# EasyEDA Pro project PR.eprj, board 新大符2.0（下单PCB） (continued)
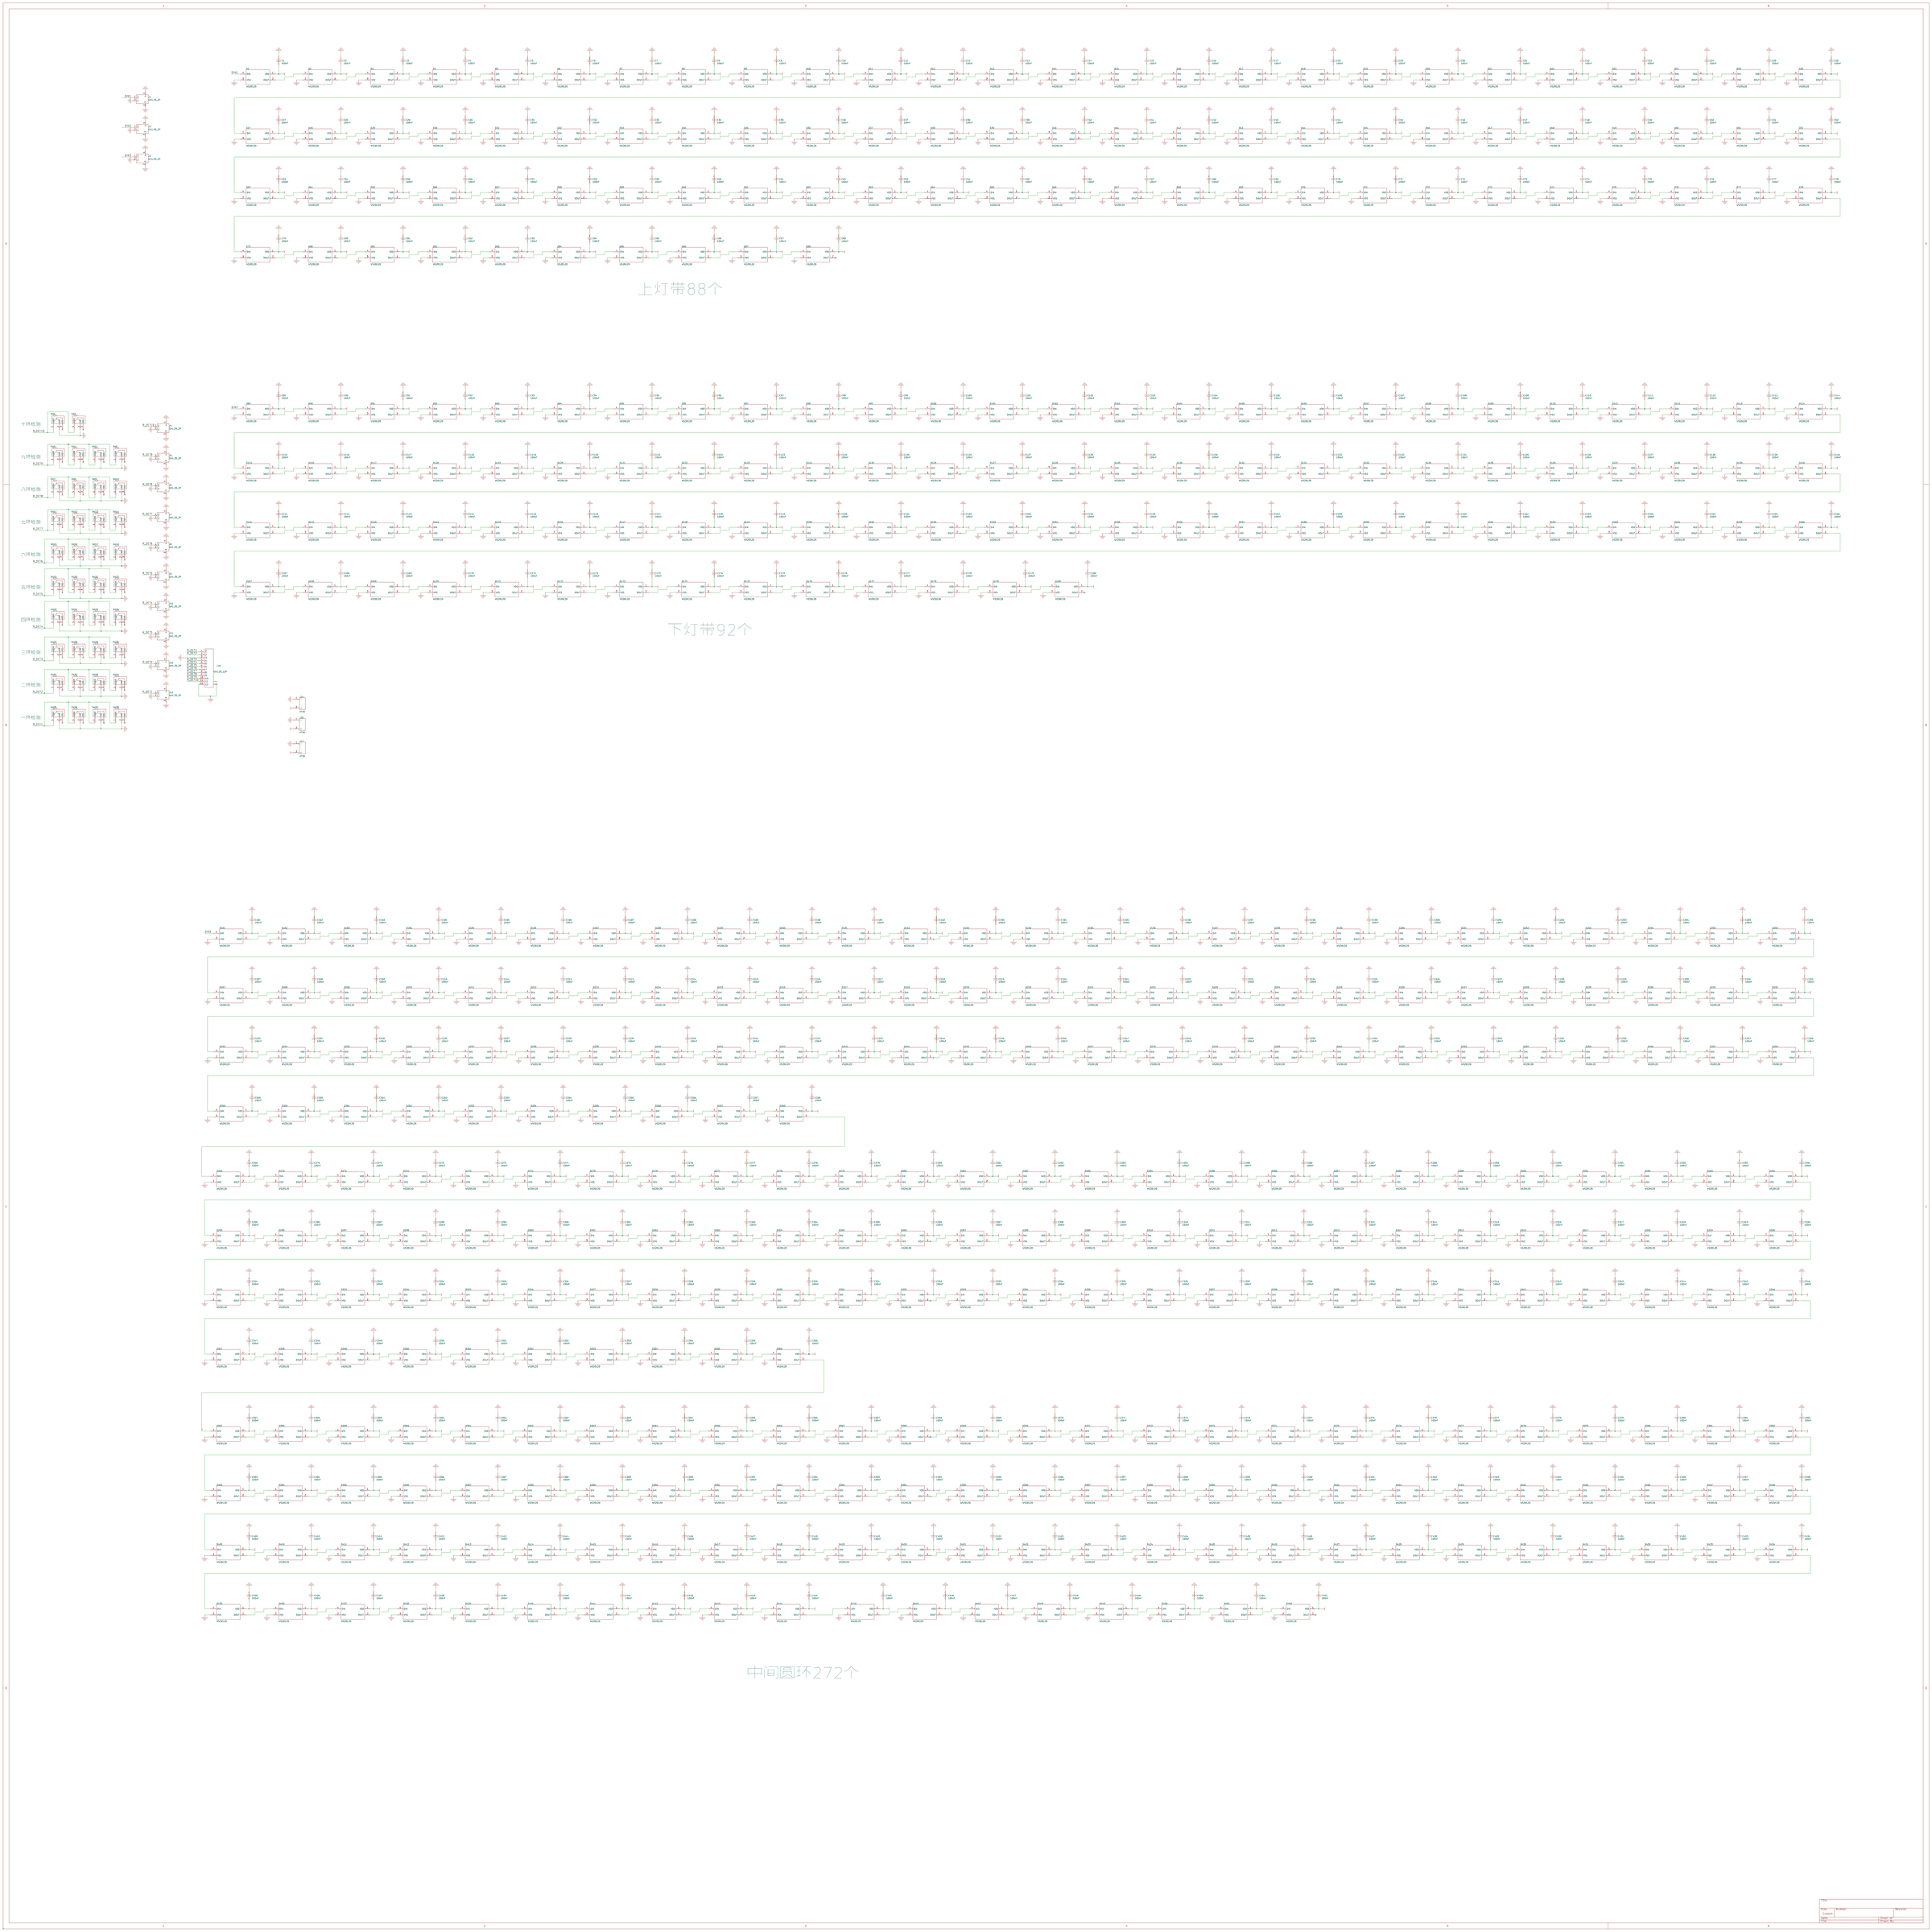
[diagram p0: schematic sheet]
## Routing (per net, layer and track width the routed paths; a pad name or vN(x,y) marks a point on that pad's centre or on a via; arc(x,y) is an arc through that point) (continued)
NETD114_2: length 8.5
  Top Layer w0.381: D115.4 92.55,38.73 arc(93.1,39.55) 93.3,40.52 D114.2
NETD115_2: length 7.7
  Top Layer w0.381: D115.2 89.87,28.82 arc(89.67,27.84) 89.12,27.02 87.68,25.58 arc(86.86,25.03) 85.89,24.84 D116.4
NETD116_2: length 34.1
  Top Layer w0.381: D116.2 86.16,19.52 107.42,44.55 D117.4
NETD117_2: length 9.1
  Top Layer w0.381: 109.33,39.24 109.33,38.52 arc(109.14,37.55) 108.59,36.73 D118.4
NETD118_2: length 8.4
  Top Layer w0.381: D118.2 105.49,26.15 arc(105.29,25.18) 104.74,24.35 102.54,22.15 arc(101.72,21.6) 100.75,21.41 D119.4
NETD119_2: length 33
  Top Layer w0.381: D119.2 101.65,16.1 123.01,39.53 D120.4
NETD120_2: length 9.1
  Top Layer w0.381: D121.4 119.8,28.39 arc(120.77,28.59) 121.59,29.14 124.17,31.72 arc(124.73,32.54) 124.92,33.51 D120.2
NETD121_2: length 8.1
  Top Layer w0.381: D122.4 116.24,18.23 arc(117.21,18.43) 118.04,18.98 119.73,20.67 arc(120.28,21.49) 120.47,22.47 D121.2
NETD122_2: length 31.7
  Top Layer w0.381: D123.4 135.58,36.74 116.64,12.92 D122.2
NETD123_2: length 8
  Top Layer w0.381: D123.2 137.49,31.38 arc(137.3,30.41) 136.75,29.58 D124.4
NETD124_2: length 7.9
  Top Layer w0.381: D125.4 arc(129.43,14.31) 130.04,14.73 133.23,17.92 arc(133.75,18.7) D124.2
NETD125_2: length 32.2
  Top Layer w0.381: D126.4 148.79,33.82 130.61,8.86 D125.2
NETD126_2: length 8
  Top Layer w0.381: D127.4 146.47,23.44 arc(147.44,23.63) 148.26,24.18 149.37,25.29 arc(150.23,26.5) 150.66,27.92 D126.2
NETD127_2: length 7.5
  Top Layer w0.381: D128.4 146.27,15.49 arc(146.82,16.31) 147.02,17.28 D127.2
NETD128_2: length 31.6
  Top Layer w0.381: D128.2 144.58,6.57 146.33,9.69 arc(146.33,9.7) 146.34,9.71 158.06,33.77 D129.4
NETD129_2: length 7.5
  Top Layer w0.381: D130.4 160.93,24.7 arc(161.48,25.52) 161.67,26.5 D129.2
NETD130_2: length 8.8
  Top Layer w0.381: D130.2 162.42,16.03 arc(162.23,15.06) 161.68,14.23 159.41,11.97 arc(158.72,11.5) D131.4
NETD131_2: length 30.4
  Top Layer w0.381: D132.4 172.81,33.89 161.51,7 D131.2
NETD132_2: length 7.8
  Top Layer w0.381: D133.4 175.67,25.27 arc(176.22,26.09) 176.42,27.06 D132.2
NETD133_2: length 8.3
  Top Layer w0.381: D133.2 176.6,16.5 arc(176.41,15.53) 175.86,14.71 D134.4
NETD134_2: length 30.1
  Top Layer w0.381: D134.2 176.1,7 186.58,33.89 D135.4
NETD135_2: length 7.7
  Top Layer w0.381: D135.2 190.19,26.66 arc(190,25.69) 189.45,24.86 D136.4
NETD136_2: length 8.1
  Top Layer w0.381: D136.2 190.78,16.1 arc(190.59,15.13) 190.04,14.3 D137.4
NETD137_2: length 30.2
  Top Layer w0.381: D137.2 190.68,7 201.35,33.89 D138.4
NETD138_2: length 7.9
  Top Layer w0.381: D138.2 204.96,27.25 arc(204.77,26.28) 204.22,25.45 D139.4
NETD139_2: length 7.9
  Top Layer w0.381: D140.4 204.22,13.9 arc(204.77,14.72) 204.96,15.69 D139.2
NETD140_2: length 30.4
  Top Layer w0.381: D141.4 213.81,34.89 205.27,7 D140.2
NETD141_2: length 7.8
  Top Layer w0.381: 216.77,23.57 216.98,24.18 217.78,28.49 arc(217.78,28.51) 217.79,28.54 217.91,30.64 D141.2
NETD142_2: length 8
  Top Layer w0.381: D142.2 220.66,18.72 220.58,16.48 arc(220.57,16.42) 220.56,16.36 219.01,12.26 D143.4
NETD143_2: length 30.9
  Top Layer w0.381: D143.2 223.11,8 227.42,37.34 D144.4
NETD144_2: length 7.9
  Top Layer w0.381: D144.2 231.52,33.08 231.5,30.97 arc(231.5,30.95) 231.5,30.93 231.03,26.48 D145.4
NETD145_2: length 7.7
  Top Layer w0.381: D146.4 233.87,14.67 234.67,18.84 arc(234.68,18.87) 234.68,18.9 234.72,21.02 D145.2
NETD146_2: length 31.1
  Top Layer w0.381: D147.4 241.02,40.13 237.97,10.42 D146.2
NETD147_2: length 8.1
  Top Layer w0.381: D147.2 245.12,35.88 245.09,29.02 244.88,28.42
NETD148_2: length 8
  Top Layer w0.381: D149.4 247.91,16.92 248.64,21.39 arc(248.65,21.41) 248.65,21.43 248.78,23.56 D148.2
NETD149_2: length 31.1
  Top Layer w0.381: 254.83,43.02 254.62,42.42 252.01,12.67 251.8,12.07
NETD150_2: length 8.2
  Top Layer w0.381: D151.4 258.19,31.48 arc(258.74,32.3) 258.93,33.28 D150.2
NETD151_2: length 7.9
  Top Layer w0.381: D152.4 261.56,19.5 261.56,26.1 D151.2
NETD152_2: length 31.2
  Top Layer w0.381: D152.2 265.66,15.24 268.23,45.08 D153.4
NETD153_2: length 7.8
  Top Layer w0.381: D154.4 273.2,34.35 272.33,40.83 D153.2
NETD154_2: length 8
  Top Layer w0.381: D154.2 277.1,24.64 arc(276.9,23.67) 276.35,22.85 D155.4
NETD155_2: length 30.2
  Top Layer w0.381: D155.2 279.88,18.42 281.1,47.33 D156.4
NETD156_2: length 8.4
  Top Layer w0.381: 286.71,36.22 286.81,36.85 286.26,41.68 arc(286.26,41.69) 286.26,41.7 285.88,43.86 D156.2
NETD157_2: length 7.1
  Top Layer w0.381: D157.2 291.76,32.47 arc(292.31,31.65) 292.51,30.67 D158.4
NETD158_2: length 28.4
  Top Layer w0.381: D159.4 295.96,50.26 297.38,23.15 297.28,22.52
NETD159_2: length 7.7
  Top Layer w0.381: D160.4 301.46,45.91 arc(301.3,46.72) 300.84,47.41
NETD160_2: length 7.7
  Top Layer w0.381: 306.86,28.79 306.86,34.86 arc(306.7,35.67) D160.2
NETD161_2: length 28.6
  Top Layer w0.381: D162.4 309.2,53.18 311.73,25.94 D161.2
NETD162_2: length 11.2
  Top Layer w0.381: D162.2 319.15,48.85 arc(319.7,48.03) 319.9,47.06 D163.4
NETD163_2: length 10.5
  Top Layer w0.381: D163.2 330.2,38.92 arc(330.75,38.1) 330.95,37.13 D164.4
NETD164_2: length 37.7
  Top Layer w0.381: D164.2 336.59,34.83 315.94,64.87 D165.4
NETD165_2: length 11.6
  Top Layer w0.381: D166.4 328.48,60.62 arc(328.28,61.59) 327.73,62.41 324.11,66.03 arc(323.29,66.58) 322.32,66.78 D165.2
NETD166_2: length 10.7
  Top Layer w0.381: D167.4 341.18,53.25 arc(340.98,54.22) 340.43,55.05 335.37,60.11 arc(334.84,60.46) 334.21,60.59
NETD167_2: length 10.6
  Top Layer w0.381: 346.91,54.4 347.39,54.4 arc(348.13,54.25) 348.76,53.83 351.43,51.16 arc(352.7,49.31) 353.23,47.12 D168.4
NETD168_2: length 49.2
  Top Layer w0.381: D168.2 358.55,48.69 322.04,79.76 D169.4
NETD169_2: length 11.9
  Top Layer w0.381: D170.4 329.85,80.92 arc(329.02,81.47) 328.05,81.67 D169.2
NETD170_2: length 13.1
  Top Layer w0.381: D171.4 351.08,67.35 arc(350.89,68.32) 350.34,69.14 344.38,75.1 arc(343.56,75.65) 342.59,75.84 D170.2
NETD171_2: length 40.5
  Top Layer w0.381: 325.92,94.75 326.34,94.27 356.4,69.09 D171.2
NETD172_2: length 10.3
  Top Layer w0.381: D172.2 331.78,96.17 arc(332.75,95.98) 333.58,95.43 338.74,90.27 arc(338.99,89.9) 339.07,89.46
NETD173_2: length 9.7
  Top Layer w0.381: D173.2 345.33,90.88 arc(346.3,90.69) 347.12,90.14 D174.4
NETD174_2: length 35.3
  Top Layer w0.381: D175.4 331.24,108.46 357.54,86.95 357.96,86.46
NETD175_2: length 16.9
  Top Layer w0.381: 336.55,110.36 339.64,110.36 arc(340.61,110.17) 341.44,109.62 D176.4
NETD176_2: length 29.4
  Top Layer w0.381: D176.2 335.74,122.47 arc(335.35,123.06) D177.4
NETD177_2: length 11.4
  Top Layer w0.381: D177.2 342.09,125.19 arc(343.06,125) 343.88,124.45 D178.4
NETD178_2: length 24.4
  Top Layer w0.381: D179.4 340.16,136.38 arc(340.35,135.41) 340.9,134.58 355.47,120.02
NETD179_2: length 8.4
  Top Layer w0.381: D180.4 351.59,135.04 arc(351.4,136.01) 350.85,136.83 348.77,138.91 arc(347.95,139.46) 346.98,139.65 D179.2
NETD181_2: length 13.9
  Top Layer w0.381: 45.33,176.75 45.12,176.75 43.69,178.18 43.69,189.83
NETD182_2: length 17.7
  Top Layer w0.381: D183.4 40.51,155.42 40.51,172.49 D182.2
NETD183_2: length 11.2
  Top Layer w0.381: D184.4 49.45,143.93 arc(49.26,144.9) 48.71,145.73 45.77,148.67 arc(45.22,149.49) 45.03,150.46 45.03,151.48
NETD184_2: length 14.1
  Top Layer w0.381: 54.33,138.55 54.33,138.24 arc(54.52,137.27) 55.07,136.45 57.17,134.34 arc(59.42,131.03) 60.27,127.11 arc(60.33,126.91) 60.5,126.77 ; 60.5,126.77 D185.4
NETD185_2: length 16.4
  Top Layer w0.381: D185.2 58.75,121.39 69.85,111.15 70.48,111.23
NETD186_2: length 13.7
  Top Layer w0.381: 80.54,99.78 79.92,99.62 69.09,105.76 68.46,105.68
NETD187_2: length 20
  Top Layer w0.381: D188.4 93.05,85.52 83.11,86.4 82.98,86.42 79.39,89.69 79.28,89.8 79.27,89.94 79.03,93.41 D187.2
NETD188_2: length 15.8
  Top Layer w0.381: 107.36,75.16 107.59,75.16 107.17,74.92 93.68,80.11 D188.2
NETD189_2: length 15.7
  Top Layer w0.381: D190.4 122.47,66.15 108.44,69.61 D189.2
NETD190_2: length 18.5
  Top Layer w0.381: D190.2 140.82,60.68 arc(141.56,60.54) 142.19,60.12
NETD191_2: length 16.5
  Top Layer w0.381: D191.2 159.41,54.44 arc(159.87,54.53) D192.4
NETD192_2: length 20.8
  Top Layer w0.381: D193.4 182.44,51.55 162.99,49.85 D192.2
NETD193_2: length 11.8
  Top Layer w0.381: D194.4 196.17,51.67 186.36,47.77 D193.2
NETD194_2: length 11.2
  Top Layer w0.381: D194.2 200.32,48.15 208.43,53.82 D195.4
NETD195_2: length 9
  Top Layer w0.381: 212.79,50.24 213.2,49.74 220.96,50.12 D196.4
NETD196_2: length 19.9
  Top Layer w0.381: 225.46,54.43 225.92,54.87 242.11,64.14 242.15,64.78
NETD197_2: length 15.7
  Top Layer w0.381: D197.2 247.26,62.39 257.68,72.43 D198.4
NETD198_2: length 15.7
  Top Layer w0.381: D198.2 263.02,71.34 272.15,82.52 D199.4
NETD199_2: length 21.1
  Top Layer w0.381: D200.4 285.85,98.61 285.7,98.6 285.59,98.49 281.18,93.79 281.15,93.73 277.23,84.1 277.23,83.99 277.24,83.95 D199.2
NETD200_2: length 14.5
  Top Layer w0.381: D201.4 298.31,110.27 292.66,98.31 D200.2
NETD201_2: length 15.4
  Top Layer w0.381: D201.2 303.67,111.22 306.77,125.03 D202.4
NETD202_2: length 13.3
  Top Layer w0.381: 313.85,138.94 314.26,138.45 311.97,126.64 312.31,126.1
NETD203_2: length 15.6
  Top Layer w0.381: D204.4 319.91,155.05 319.22,140.7 D203.2
NETD204_2: length 15.7
  Top Layer w0.381: 322.99,172.7 323.5,172.32 324.54,157.9 D204.2
NETD205_2: length 16
  Top Layer w0.381: D205.2 327.75,175.74 325.13,190.19 324.57,190.5
NETD206_2: length 15.5
  Top Layer w0.381: D206.2 328.92,194.11 324.09,207.54 D207.4
NETD207_2: length 18
  Top Layer w0.381: 327.95,211.66 328.46,212.04 327.45,228.71 D208.4
NETD208_2: length 12.4
  Top Layer w0.381: D209.4 315.91,241.79 320.7,238.69 arc(320.79,238.61) 320.85,238.51 ; D208.2 322.7,233.67 320.85,238.51
NETD209_2: length 15.7
  Top Layer w0.381: D209.2 317.98,246.83 308.66,257.88 D210.4
NETD210_2: length 15.7
  Top Layer w0.381: D210.2 310.09,263.14 299.46,272.94 D211.4
NETD211_2: length 12.1
  Top Layer w0.381: 290.87,284.55 291.48,284.71 300.21,278.33 D211.2
NETD212_2: length 21.6
  Top Layer w0.381: D213.4 275.78,299.01 286.51,298.25 286.62,298.24 288.81,296.66 288.86,296.6 288.88,296.56 292.37,290.92 D212.2
NETD213_2: length 15.7
  Top Layer w0.381: D214.4 261.68,309.62 275.17,304.43 275.77,304.66
NETD214_2: length 15.7
  Top Layer w0.381: D214.2 260.4,314.92 246.36,318.38 245.85,318.01
NETD215_2: length 15.7
  Top Layer w0.381: D216.4 230.07,325.15 244.43,323.47 D215.2
NETD216_2: length 15.7
  Top Layer w0.381: 212.64,329.33 213.05,329.83 227.51,329.96 D216.2
NETD217_2: length 11.5
  Top Layer w0.381: D218.4 199.96,331.87 209.91,334.27 210.32,334.76
NETD218_2: length 11.5
  Top Layer w0.381: D219.4 186.36,333.26 196.28,335.89 D218.2
NETD219_2: length 19.5
  Top Layer w0.381: D220.4 165.23,331.22 182.44,337.04 D219.2
NETD220_2: length 14
  Top Layer w0.381: 160.87,334.8 160.46,335.29 147.72,335.32 D221.4
NETD221_2: length 20.7
  Top Layer w0.381: D221.2 142.76,330.58 126.53,319.92 D222.4
NETD222_2: length 14.3
  Top Layer w0.381: 111.71,312.34 111.67,312.98 121.38,321.67 D222.2
NETD223_2: length 15.6
  Top Layer w0.381: D223.2 106.34,314.07 97.33,302.94 97.45,302.31
NETD224_2: length 23.1
  Top Layer w0.381: D224.2 91.94,303.83 91.94,294.52 84.48,287.05 82.47,287.05 82.3,286.88 81.83,286.88 D225.4
NETD225_2: length 12.9
  Top Layer w0.381: D225.2 76.02,287.39 72.66,276.32 D226.4
NETD226_2: length 13.8
  Top Layer w0.381: D227.4 62.8,263.7 67.3,275.37 67.03,275.95
NETD227_2: length 18.8
  Top Layer w0.381: D228.4 54.68,244.84 57.6,262.08 D227.2
NETD228_2: length 14.4
  Top Layer w0.381: 49.31,243.08 49.72,242.59 48.93,229.48 D229.4
NETD229_2: length 15.7
  Top Layer w0.381: D230.4 45.33,212.21 44.29,226.63 D229.2
NETD230_2: length 25
  Top Layer w0.381: 40.57,209.17 41.09,208.79 48.42,203.09 59.8,194.24 D231.4
NETD231_2: length 14.5
  Top Layer w0.381: D232.4 58.75,177.37 56.02,190.32 D231.2
NETD232_2: length 15
  Top Layer w0.381: 55.05,158.53 55.2,159.15 54.44,172.8 D232.2
NETD233_2: length 14.7
  Top Layer w0.254: D233.2 60.03,154.15 67.64,143.34 D234.4
NETD234_2: length 15.8
  Top Layer w0.254: D234.2 65.95,138.15 75.59,127.56 D235.4
NETD235_2: length 15.8
  Top Layer w0.254: 73.91,122.18 74.63,122.19 85.65,113.04 D236.4
NETD236_2: length 18.8
  Top Layer w0.381: D237.4 98.5,100.45 98.5,103.43 94.29,107.64 84.9,107.64 84.73,107.48
NETD237_2: length 15.8
  Top Layer w0.254: D238.4 111.31,88.89 98.2,94.65 D237.2
NETD238_2: length 15.8
  Top Layer w0.254: D238.2 112.62,83.6 126.41,79.72 D239.4
NETD239_2: length 17.4
  Top Layer w0.254: D239.2 128.45,74.66 144.31,72.85 144.86,73.33
NETD240_2: length 17.3
  Top Layer w0.254: D241.4 162.92,67.81 147.03,68.12 146.48,67.65
NETD241_2: length 17.5
  Top Layer w0.254: D241.2 166.27,63.51 182.25,65.07 D242.4
NETD242_2: length 11.2
  Top Layer w0.254: D242.2 186.3,61.42 194.87,66.08 D243.4
NETD243_2: length 18.7
  Top Layer w0.254: D243.2 199.35,62.17 216.82,64.01 D244.4
NETD244_2: length 10.4
  Top Layer w0.254: D245.4 229.24,73.85 221.9,68.79 D244.2
NETD245_2: length 15.9
  Top Layer w0.254: D245.2 234.36,71.98 245.37,81.34 245.38,82.07
NETD246_2: length 15.6
  Top Layer w0.254: 250.69,79.48 250.7,80.2 260.14,90.79 260.06,91.51
NETD247_2: length 24.3
  Top Layer w0.254: D247.2 265.96,89.92 276.97,99.08 arc(278.16,100.64) 278.54,102.57 278.49,104.45 278.48,104.48 D248.4
NETD248_2: length 9.6
  Top Layer w0.254: D249.4 285.18,115.6 283.14,107.76 D248.2
NETD249_2: length 15.8
  Top Layer w0.254: D249.2 290.51,116.72 294.87,130.37 D250.4
NETD250_2: length 15.8
  Top Layer w0.254: D251.4 302.41,146.34 300,132.22 D250.2
NETD251_2: length 15.8
  Top Layer w0.254: D252.4 307.65,163.21 307.23,148.89 D251.2
NETD252_2: length 24.9
  Top Layer w0.254: D253.4 311.35,189.87 312.07,166.41 D252.2
NETD253_2: length 13.5
  Top Layer w0.254: D254.4 309.6,204.74 315.01,193.92 315.63,193.55
NETD254_2: length 18.2
  Top Layer w0.254: D255.4 313.94,225.84 314.2,209.12 D254.2
NETD255_2: length 9.1
  Top Layer w0.254: D256.4 303.27,235.85 309.16,230.92 D255.2
NETD256_2: length 12.9
  Top Layer w0.254: D256.2 305.32,240.91 297.5,249.22 D257.4
NETD257_2: length 15.8
  Top Layer w0.254: D257.2 298.82,254.51 288.47,264.41 D258.4
NETD258_2: length 12.9
  Top Layer w0.254: D259.4 278.95,275.29 289.05,269.83 D258.2
NETD259_2: length 23
  Top Layer w0.254: D259.2 279.65,281 279.75,281.1 279.75,283.9 272.84,291.37 272.83,291.37 272.8,291.41 270.35,292.49 270.25,292.49 270.2,292.47 D260.4
NETD260_2: length 15.8
  Top Layer w0.254: D261.4 250.13,300.49 263.62,295.66 264.29,295.92
NETD261_2: length 15.8
  Top Layer w0.254: 249.09,306.03 248.45,305.68 234.43,308.58 D262.4
NETD262_2: length 15.8
  Top Layer w0.254: 217.24,313.9 217.75,314.41 232.05,313.49 D262.2
NETD263_2: length 15.8
  Top Layer w0.254: D263.2 214.71,318.94 200.43,317.86 D264.4
NETD264_2: length 12
  Top Layer w0.254: D265.4 186.55,319.23 196.79,321.92 D264.2
NETD265_2: length 19.2
  Top Layer w0.254: D265.2 182.51,322.88 165.63,317.45 D266.4
NETD266_2: length 10.9
  Top Layer w0.254: D266.2 160.8,321.57 151.36,320.8 D267.4
NETD267_2: length 18.4
  Top Layer w0.254: D268.4 131.78,307.22 146.27,316.02 D267.2
NETD268_2: length 16
  Top Layer w0.254: D268.2 126.54,308.73 115.95,298.77 D269.4
NETD269_2: length 15.8
  Top Layer w0.254: D269.2 110.55,299.54 101.8,288.21 D270.4
NETD270_2: length 18.4
  Top Layer w0.254: 89.48,275.09 88.18,278.86 88.17,278.9 88.17,278.97 89.66,284.98 89.72,285.04 94.15,289.03 94.26,289.03 D270.2
NETD271_2: length 15.8
  Top Layer w0.254: D272.4 78.55,261.72 83.85,275.02 83.61,275.71
NETD272_2: length 15.8
  Top Layer w0.254: D272.2 73.31,260.22 69.92,246.31 70.33,245.71
NETD273_2: length 15.8
  Top Layer w0.254: 64.51,244.69 64.93,244.1 64.04,229.79 64.53,229.26
NETD274_2: length 15.7
  Top Layer w0.254: D275.4 59.46,212.65 59.41,226.91 58.91,227.44
NETD275_2: length 25.4
  Top Layer w0.254: D275.2 55.27,209.15 74.22,194.56 D276.4
NETD276_2: length 14
  Top Layer w0.254: 74.68,177.92 70.56,190.51 D276.2
NETD277_2: length 13.4
  Top Layer w0.254: 70.8,160.82 71,161.52 69.78,173.42 D277.2
NETD278_2: length 15.6
  Top Layer w0.254: D279.4 83.82,144.8 75.77,156.43 D278.2
NETD279_2: length 15.6
  Top Layer w0.254: D280.4 92.52,129.68 82.4,139.54 D279.2
NETD280_2: length 26.4
  Top Layer w0.254: D281.4 109.49,110.83 109.48,110.79 109.41,110.72 104.7,109.35 arc(103.02,109.38) 101.65,110.37 91.45,123.89 D280.2
NETD281_2: length 13.2
  Top Layer w0.254: D281.2 109.36,105.74 120.85,103.38 121.52,103.66
NETD282_2: length 11.3
  Top Layer w0.254: 121.31,97.76 121.97,98.04 131.49,95.38 D283.4
NETD283_2: length 15.2
  Top Layer w0.254: 147.54,88.23 146.99,87.75 133.43,90.29 132.82,89.91
NETD284_2: length 15.6
  Top Layer w0.254: D285.4 163.84,83.21 149.71,83.02 149.16,82.55
NETD285_2: length 16.8
  Top Layer w0.254: D286.4 182.38,81.46 167.27,78.97 D285.2
NETD286_2: length 14.9
  Top Layer w0.254: D286.2 186.43,77.8 199.11,82.14 199.38,82.82
NETD287_2: length 13.3
  Top Layer w0.254: D288.4 215.68,79.25 203.87,77.94 203.4,78.49
NETD288_2: length 15.7
  Top Layer w0.254: D288.2 220.76,84.03 232.48,92.08 232.53,92.8
NETD289_2: length 17
  Top Layer w0.381: D289.2 237.72,90.57 248.89,101.6 248.81,102.23
NETD290_2: length 22
  Top Layer w0.381: D290.2 254.28,100.84 260.06,114.35 arc(260.1,114.42) 260.16,114.48 263.04,117.13 arc(263.13,117.19) 263.23,117.22 264.94,117.53 D291.4
NETD291_2: length 10.3
  Top Layer w0.381: D291.2 271.18,116.83 273.29,125.64 D292.4
NETD292_2: length 14.5
  Top Layer w0.381: 281.55,139.93 281.91,139.4 278.65,126.59 278.92,126.01
NETD293_2: length 15.6
  Top Layer w0.381: D293.2 287.06,141.18 289.02,155.33 D294.4
NETD294_2: length 15.6
  Top Layer w0.381: 293.05,172.56 293.55,172.17 293.83,157.89 D294.2
NETD295_2: length 15.6
  Top Layer w0.381: 298.4,175.06 297.9,175.45 295.39,189.51 D296.4
NETD296_2: length 15.7
  Top Layer w0.381: 293.88,207.28 294.48,207.06 299.17,193.43 D296.2
NETD297_2: length 11.6
  Top Layer w0.381: D298.4 297.98,221.98 298.7,211.7 298.2,211.31
NETD298_2: length 17.2
  Top Layer w0.381: D299.4 284.65,240.29 293.24,226.94 D298.2
NETD299_2: length 15.6
  Top Layer w0.381: D299.2 286.24,245.5 275.94,255.4 D300.4
NETD300_2: length 10.5
  Top Layer w0.381: D301.4 268.29,264.56 276.7,260.79 D300.2
NETD301_2: length 24.8
  Top Layer w0.381: D301.2 269.48,270.55 269.58,270.65 270.14,272.59 270.14,272.76 arc(267.44,275.79) 263.95,277.88 254.51,281.74 254.35,281.74 254.27,281.7 D302.4
NETD302_2: length 15.6
  Top Layer w0.381: D303.4 237.41,290.16 251.08,286.01 D302.2
NETD303_2: length 15.6
  Top Layer w0.381: D303.2 235.63,295.31 221.48,297.27 D304.4
NETD304_2: length 15.5
  Top Layer w0.381: 219.39,302.52 218.92,302.08 204.71,301.86 D305.4
NETD305_2: length 16.3
  Top Layer w0.381: D305.2 201.43,306.21 186.62,303.8 D306.4
NETD306_2: length 15
  Top Layer w0.381: 169.66,302.15 169.88,302.75 182.7,307.58 183.01,308.14
NETD307_2: length 11.4
  Top Layer w0.381: 154.47,307.03 155.09,306.87 165.24,306.98 D307.2
NETD308_2: length 17.7
  Top Layer w0.381: D309.4 136.52,292.9 150.13,302.13 150.59,302.57
NETD309_2: length 15.6
  Top Layer w0.381: D309.2 131.31,294.49 121.41,284.2 D310.4
NETD310_2: length 11
  Top Layer w0.381: D311.4 111.43,276.4 116.02,284.95 115.94,285.59
NETD311_2: length 21.2
  Top Layer w0.381: D311.2 105.37,276.98 105.34,276.99 105.19,276.99 101.72,274.41 101.65,274.34 95.69,261.45 95.69,261.28 95.73,261.21 D312.4
NETD312_2: length 15.6
  Top Layer w0.381: D313.4 86.64,245.66 90.8,259.34 D312.2
NETD313_2: length 15.6
  Top Layer w0.381: 81.14,244.42 81.5,243.89 79.54,229.74 D314.4
NETD314_2: length 15.6
  Top Layer w0.381: D315.4 75,212.89 74.73,227.18 D314.2
NETD315_2: length 24.6
  Top Layer w0.381: 70.15,210.01 70.66,209.61 88.25,194.24 D316.4
NETD316_2: length 14.3
  Top Layer w0.381: D316.2 84.47,190.32 89.49,178.33 D317.4
NETD317_2: length 9.4
  Top Layer w0.381: D318.4 84.41,165.5 85.37,173.6 D317.2
NETD318_2: length 19.9
  Top Layer w0.381: 88.72,161 89.16,160.54 100.46,145.78 D319.4
NETD319_2: length 15.4
  Top Layer w0.381: D320.4 110.12,131.5 99.22,140.48 D319.2
NETD320_2: length 18
  Top Layer w0.381: D320.2 108.98,124.3 108.98,124.28 108.98,124.1 113.12,119.36 113.23,119.26 120.37,118.46 120.46,118.46 120.53,118.49 D321.4
NETD321_2: length 15.4
  Top Layer w0.381: D322.4 136.23,109.18 122.87,113.76 122.28,113.52
NETD322_2: length 16.2
  Top Layer w0.381: D322.2 137.89,103.99 152.72,102.53 D323.4
NETD323_2: length 14.5
  Top Layer w0.381: D324.4 168.51,97.46 155.28,97.72 154.81,97.28
NETD324_2: length 12.3
  Top Layer w0.381: 171.51,92.68 171.89,93.19 182.44,96.25 D325.4
NETD325_2: length 14.4
  Top Layer w0.381: D326.4 198.79,96.82 186.36,92.47 D325.2
NETD326_2: length 18.3
  Top Layer w0.381: D327.4 218.5,102.27 203.55,94.19 D326.2
NETD327_2: length 13.6
  Top Layer w0.381: D328.4 232.65,108.7 223.58,100.33 223.52,99.7
NETD328_2: length 14.6
  Top Layer w0.381: D328.2 238.01,107.71 246.2,118.25 D329.4
NETD329_2: length 20.8
  Top Layer w0.381: 259.65,133.56 260.88,130.94 260.91,130.86 260.91,130.72 257.68,120.53 257.62,120.46 254.74,117.71 254.6,117.7 D329.2
NETD330_2: length 15.7
  Top Layer w0.381: D330.2 265.29,133.93 269.85,147.62 D331.4
NETD331_2: length 21
  Top Layer w0.381: D331.2 274.95,149.51 277.33,169.09 276.87,169.54
NETD332_2: length 19.8
  Top Layer w0.381: D333.4 280.56,190.32 282.02,171.86 D332.2
NETD333_2: length 10.9
  Top Layer w0.381: 279.39,203.12 279.98,202.86 284.34,194.24 D333.2
NETD334_2: length 12.2
  Top Layer w0.381: 283.98,206.84 284.51,207.2 283.63,218.04 283.79,218.66